# EasyEDA Pro project FOX_HTOL_1.0.eprj, board PCB1 (continued)
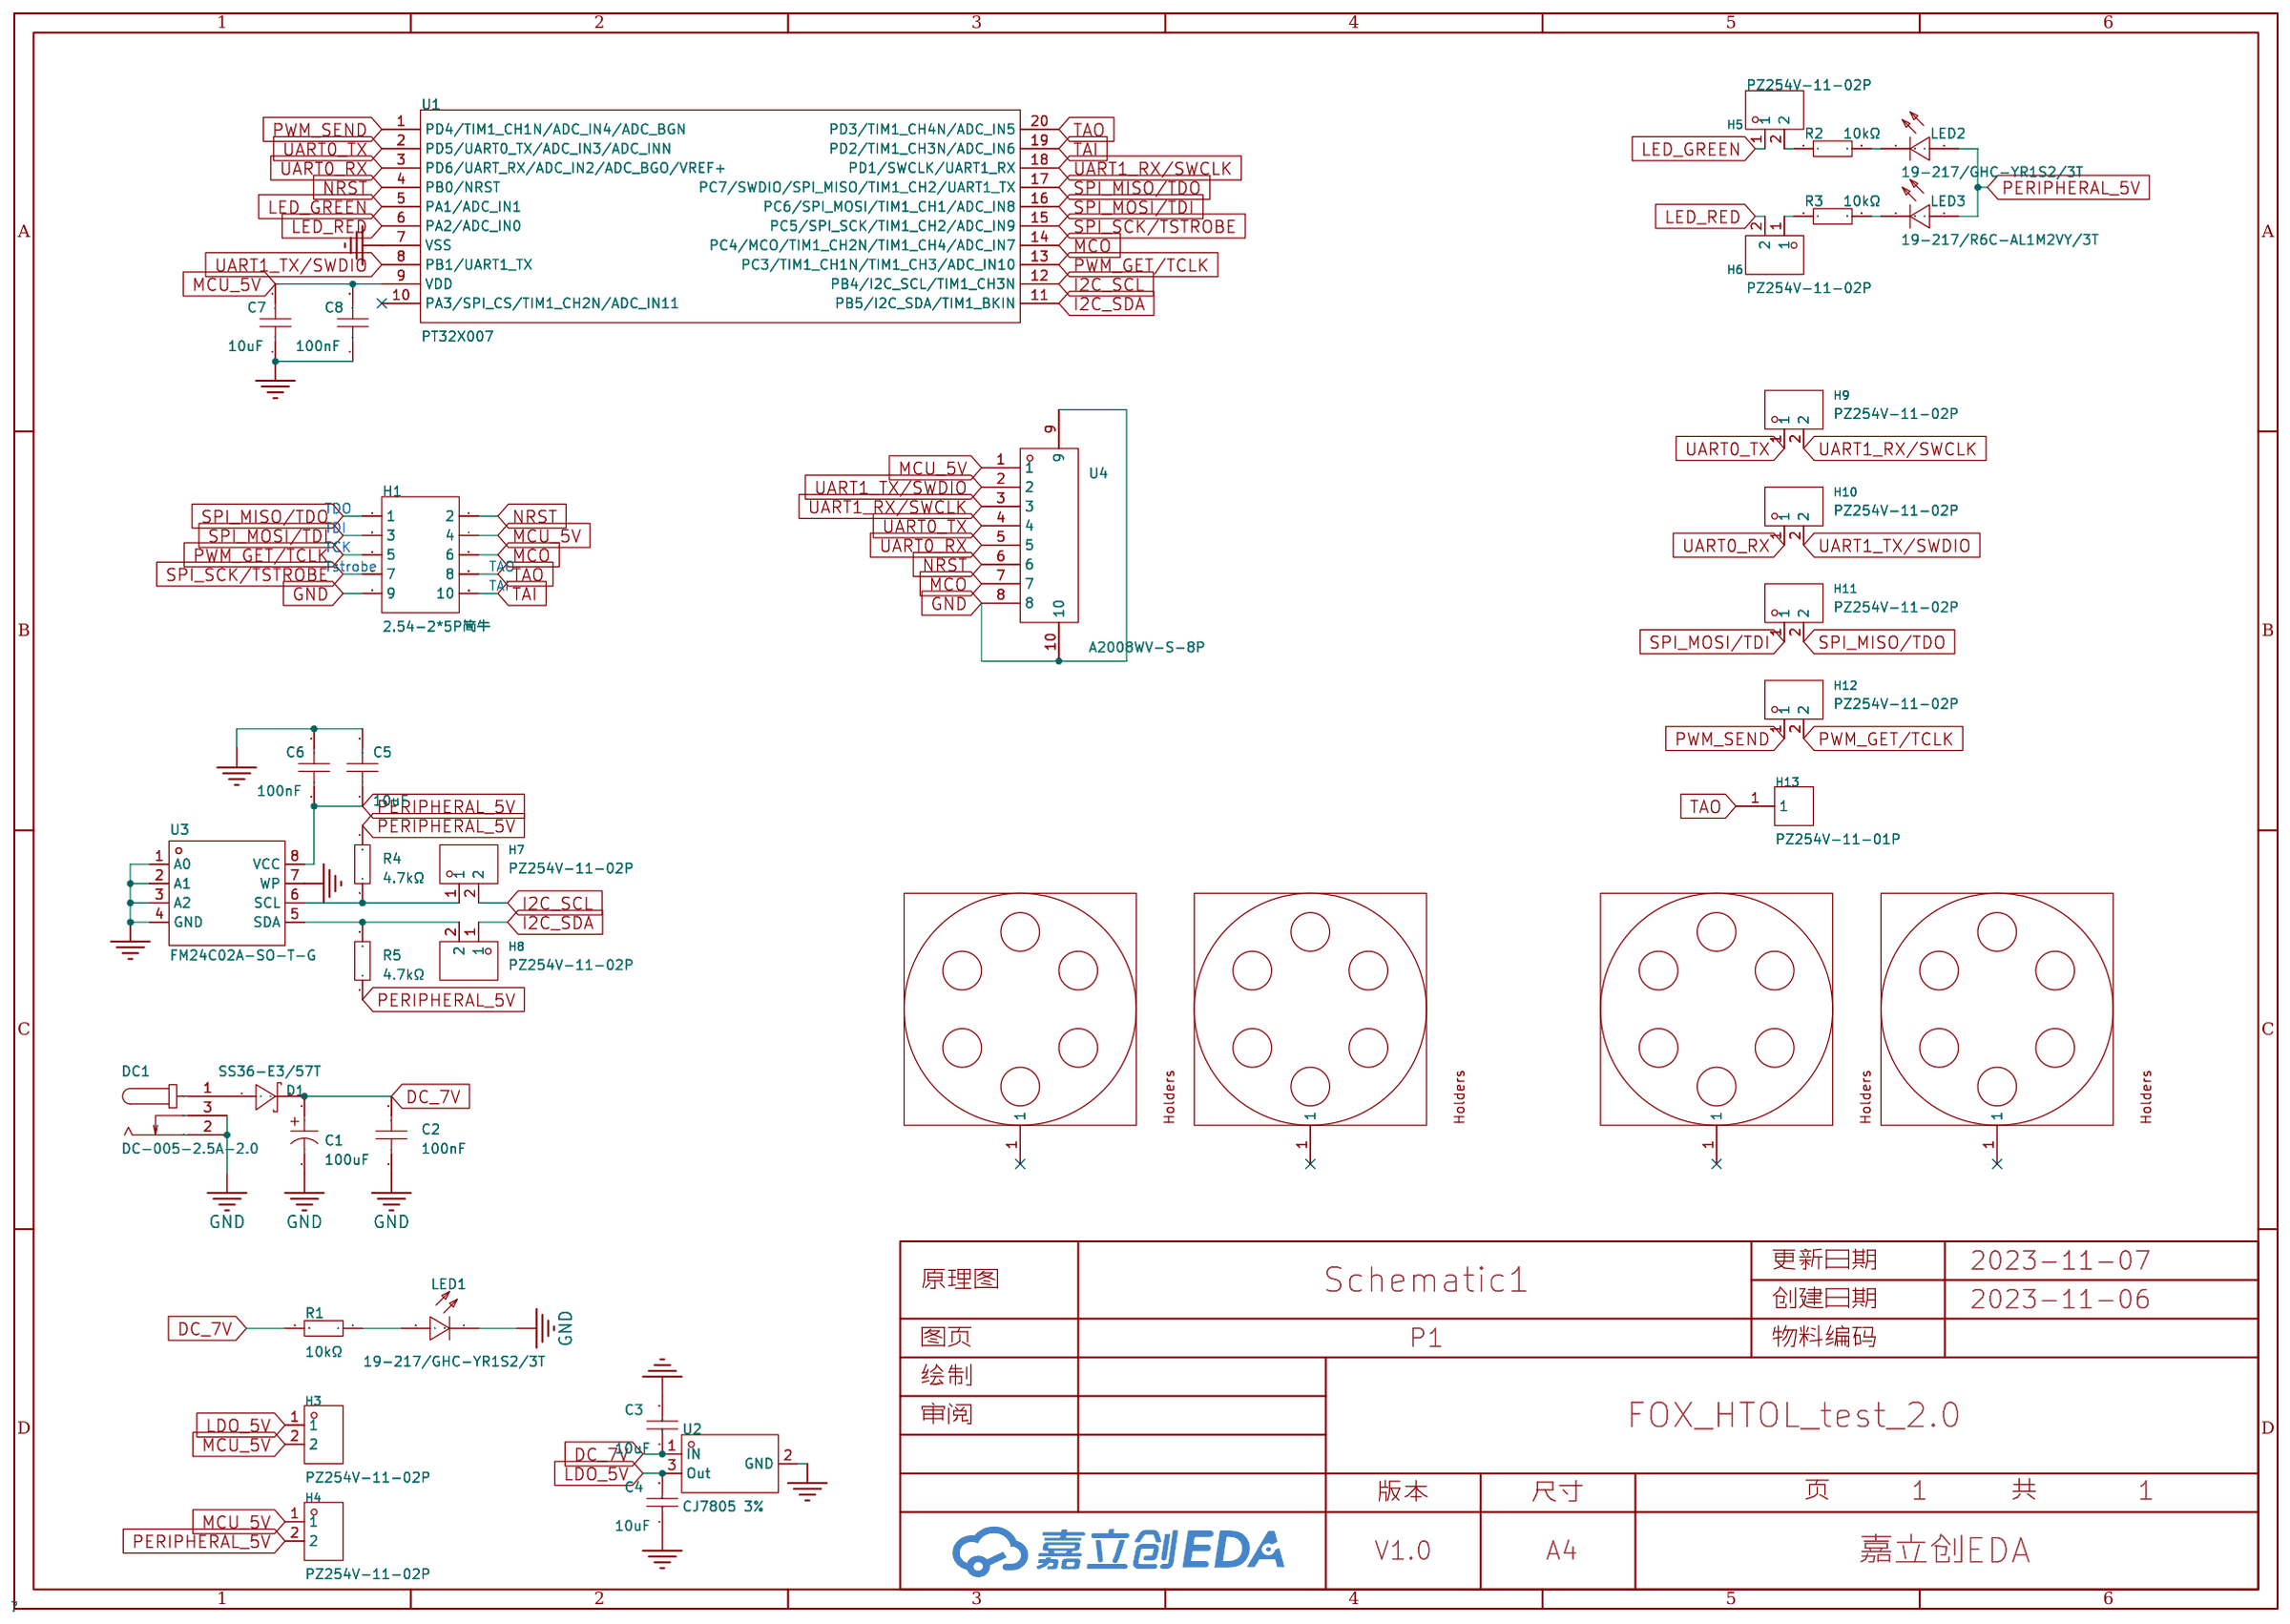
[diagram p0: schematic sheet]
## Routing (per net, layer and track width the routed paths; a pad name or vN(x,y) marks a point on that pad's centre or on a via; arc(x,y) is an arc through that point) (continued)
UART1_RX/SWCLK: length 2204.8
  Top Layer w0.254: U1#28.18 64.22,89.16 66.23,87.16 69.28,87.16 71.44,89.31 71.44,92.74 72.66,93.96 U4#24.3 77.99,93.96 78.55,94.52 78.55,100.24 76.64,102.14 44.39,102.14 43.12,100.87 43.12,98.84 H9#30.2 ; U1#25.18 64.22,57.04 66.23,55.03 69.28,55.03 71.44,57.19 71.44,60.62 72.66,61.84 77.99,61.84 78.55,62.4 78.55,68.11 76.64,70.02 44.39,70.02 43.12,68.75 43.12,66.71 H9#31.2 ; H9.2 119.95,34.59 119.95,36.62 121.22,37.89 153.47,37.89 155.38,35.99 155.38,30.27 154.82,29.72 U4#12.3 149.49,29.72 148.27,28.49 148.27,25.06 146.11,22.91 143.06,22.91 141.05,24.91 U1#12.18 ; U1#11.18 141.05,57.04 143.06,55.03 146.11,55.03 148.27,57.19 148.27,60.62 149.49,61.84 154.82,61.84 155.38,62.4 155.38,68.11 153.47,70.02 121.22,70.02 119.95,68.75 119.95,66.71 H9#16.2 ; U1#13.18 141.05,217.66 143.06,215.65 146.11,215.65 148.27,217.81 148.27,221.24 149.49,222.46 U4#16.3 154.82,222.46 155.38,223.02 155.38,228.73 153.47,230.64 121.22,230.64 119.95,229.37 119.95,227.34 H9#12.2 ; U1#24.18 64.22,121.29 66.23,119.28 69.28,119.28 71.44,121.44 71.44,124.87 72.66,126.09 U4#32.3 77.99,126.09 78.55,126.65 78.55,132.36 76.64,134.27 44.39,134.27 43.12,133 43.12,130.96 H9#24.2 ; H9#14.2 119.95,163.09 119.95,165.12 121.22,166.39 153.47,166.39 155.38,164.48 155.38,158.77 154.82,158.21 U4#14.3 149.49,158.21 148.27,156.99 148.27,153.56 146.11,151.4 143.06,151.4 141.05,153.41 U1#17.18 ; U1#18.18 25.81,153.41 27.81,151.4 30.86,151.4 33.02,153.56 33.02,156.99 34.24,158.21 U4#19.3 39.58,158.21 40.13,158.77 40.13,164.48 38.23,166.39 5.97,166.39 4.7,165.12 4.7,163.09 H9#19.2 ; H9#17.2 119.95,195.21 119.95,197.24 121.22,198.51 153.47,198.51 155.38,196.61 155.38,190.89 154.82,190.34 U4#13.3 149.49,190.34 148.27,189.12 148.27,185.69 146.11,183.53 143.06,183.53 141.05,185.53 U1#16.18 ; U1#6.18 102.64,89.16 104.65,87.16 107.69,87.16 109.85,89.31 109.85,92.74 111.07,93.96 U4.3 116.41,93.96 116.96,94.52 116.96,100.24 115.06,102.14 82.8,102.14 81.53,100.87 81.53,98.84 H9#7.2 ; H9#5.2 81.53,259.46 81.53,261.49 82.8,262.76 115.06,262.76 116.96,260.86 116.96,255.14 116.41,254.59 U4#6.3 111.07,254.59 109.85,253.36 109.85,249.94 107.69,247.78 104.65,247.78 102.64,249.78 100.78,249.78 ; 23.95,249.78 25.81,249.78 27.81,247.78 30.86,247.78 33.02,249.94 33.02,253.36 34.24,254.59 U4#9.3 39.58,254.59 40.13,255.14 40.13,260.86 38.23,262.76 5.97,262.76 4.7,261.49 4.7,259.46 H9#10.2 ; H9#29.2 43.12,163.09 43.12,165.12 44.39,166.39 76.64,166.39 78.55,164.48 78.55,158.77 77.99,158.21 U4#28.3 72.66,158.21 71.44,156.99 71.44,153.56 69.28,151.4 66.23,151.4 64.22,153.41 U1#32.18 ; H9#22.2 4.7,66.71 4.7,68.75 5.97,70.02 38.23,70.02 40.13,68.11 40.13,62.4 39.58,61.84 34.24,61.84 33.02,60.62 33.02,57.19 30.86,55.03 27.81,55.03 25.81,57.04 U1#21.18 ; U1#30.18 64.22,185.53 66.23,183.53 69.28,183.53 71.44,185.69 71.44,189.12 72.66,190.34 U4#27.3 77.99,190.34 78.55,190.89 78.55,196.61 76.64,198.51 44.39,198.51 43.12,197.24 43.12,195.21 H9#32.2 ; U1#5.18 102.64,217.66 104.65,215.65 107.69,215.65 109.85,217.81 109.85,221.24 111.07,222.46 U4#7.3 116.41,222.46 116.96,223.02 116.96,228.73 115.06,230.64 82.8,230.64 81.53,229.37 81.53,227.34 H9#3.2 ; U1#2.18 102.64,121.29 104.65,119.28 107.69,119.28 109.85,121.44 109.85,124.87 111.07,126.09 U4#8.3 116.41,126.09 116.96,126.65 116.96,132.36 115.06,134.27 82.8,134.27 81.53,133 81.53,130.96 H9#2.2 ; H9#26.2 43.12,34.59 43.12,36.62 44.39,37.89 76.64,37.89 78.55,35.99 78.55,30.27 77.99,29.72 U4#26.3 72.66,29.72 71.44,28.49 71.44,25.06 69.28,22.91 66.23,22.91 64.22,24.91 U1#26.18 ; U1#19.18 25.81,24.91 27.81,22.91 30.86,22.91 33.02,25.06 33.02,28.49 34.24,29.72 U4#20.3 39.58,29.72 40.13,30.27 40.13,35.99 38.23,37.89 5.97,37.89 4.7,36.62 4.7,34.59 H9#20.2 ; U1#31.18 25.81,185.53 27.81,183.53 30.86,183.53 33.02,185.69 33.02,189.12 34.24,190.34 U4#18.3 39.58,190.34 40.13,190.89 40.13,196.61 38.23,198.51 5.97,198.51 4.7,197.24 4.7,195.21 H9#18.2 ; U1#20.18 25.81,89.16 27.81,87.16 30.86,87.16 33.02,89.31 33.02,92.74 34.24,93.96 U4#22.3 39.58,93.96 40.13,94.52 40.13,100.24 38.23,102.14 5.97,102.14 4.7,100.87 4.7,98.84 H9#21.2 ; H9#11.2 119.95,130.96 119.95,133 121.22,134.27 153.47,134.27 155.38,132.36 155.38,126.65 154.82,126.09 U4#17.3 149.49,126.09 148.27,124.87 148.27,121.44 146.11,119.28 143.06,119.28 141.05,121.29 U1#10.18 ; U1#3.18 102.64,57.04 104.65,55.03 107.69,55.03 109.85,57.19 109.85,60.62 111.07,61.84 116.41,61.84 116.96,62.4 116.96,68.11 115.06,70.02 82.8,70.02 81.53,68.75 81.53,66.71 H9#8.2 ; H9#28.2 4.7,227.34 4.7,229.37 5.97,230.64 38.23,230.64 40.13,228.73 40.13,223.02 39.58,222.46 U4#31.3 34.24,222.46 33.02,221.24 33.02,217.81 30.86,215.65 27.81,215.65 25.81,217.66 U1#23.18 ; H9#23.2 4.7,130.96 4.7,133 5.97,134.27 38.23,134.27 40.13,132.36 40.13,126.65 39.58,126.09 U4#23.3 34.24,126.09 33.02,124.87 33.02,121.44 30.86,119.28 27.81,119.28 25.81,121.29 U1#22.18 ; U1#14.18 141.05,89.16 143.06,87.16 146.11,87.16 148.27,89.31 148.27,92.74 149.49,93.96 U4#10.3 154.82,93.96 155.38,94.52 155.38,100.24 153.47,102.14 121.22,102.14 119.95,100.87 119.95,98.84 H9#15.2 ; H9#4.2 81.53,34.59 81.53,36.62 82.8,37.89 115.06,37.89 116.96,35.99 116.96,30.27 116.41,29.72 U4#3.3 111.07,29.72 109.85,28.49 109.85,25.06 107.69,22.91 104.65,22.91 102.64,24.91 U1#4.18 ; U1#8.18 102.64,185.53 104.65,183.53 107.69,183.53 109.85,185.69 109.85,189.12 111.07,190.34 U4#4.3 116.41,190.34 116.96,190.89 116.96,196.61 115.06,198.51 82.8,198.51 81.53,197.24 81.53,195.21 H9#9.2 ; U1#9.18 102.64,153.41 104.65,151.4 107.69,151.4 109.85,153.56 109.85,156.99 111.07,158.21 U4#5.3 116.41,158.21 116.96,158.77 116.96,164.48 115.06,166.39 82.8,166.39 81.53,165.12 81.53,163.09 H9#6.2 ; 62.37,249.78 64.22,249.78 66.23,247.78 69.28,247.78 71.44,249.94 71.44,253.36 72.66,254.59 U4#29.3 77.99,254.59 78.55,255.14 78.55,260.86 76.64,262.76 44.39,262.76 43.12,261.49 43.12,259.46 H9#27.2 ; U1#27.18 64.22,217.66 66.23,215.65 69.28,215.65 71.44,217.81 71.44,221.24 72.66,222.46 U4#30.3 77.99,222.46 78.55,223.02 78.55,228.73 76.64,230.64 44.39,230.64 43.12,229.37 43.12,227.34 H9#25.2 ; 139.2,249.78 141.05,249.78 143.06,247.78 146.11,247.78 148.27,249.94 148.27,253.36 149.49,254.59 U4#15.3 154.82,254.59 155.38,255.14 155.38,260.86 153.47,262.76 121.22,262.76 119.95,261.49 119.95,259.46 H9#13.2
UART1_TX/SWDIO: length 2264.1
  Top Layer w0.254: v2(132.27,53.76) 133.43,53.76 U1#11.8 135.44,53.79 135.82,54.17 135.82,59.22 v2(135.44,59.6) ; v2(93.85,150.13) 95.02,150.13 U1#9.8 97.03,150.16 97.41,150.54 97.41,155.59 v2(97.03,155.98) ; v2(93.85,85.88) 95.02,85.88 U1#6.8 97.03,85.91 97.41,86.29 97.41,91.35 v2(97.03,91.73) ; v2(135.44,252.35) 135.82,251.97 135.82,246.91 135.44,246.53 133.46,246.53 133.43,246.51 v2(132.27,246.51) ; v2(132.27,150.13) 133.43,150.13 U1#17.8 135.44,150.16 135.82,150.54 135.82,155.59 v2(135.44,155.98) ; v2(135.44,123.85) 135.82,123.47 135.82,118.42 135.44,118.04 U1#10.8 133.43,118.01 v2(132.27,118.01) ; v2(135.44,27.48) 135.82,27.1 135.82,22.04 135.44,21.66 U1#12.8 133.43,21.64 v2(132.27,21.64) ; v2(132.27,182.26) 133.43,182.26 U1#16.8 135.44,182.28 135.82,182.66 135.82,187.72 v2(135.44,188.1) ; v2(20.19,123.85) 20.57,123.47 20.57,118.42 20.19,118.04 U1#22.8 18.19,118.01 v2(17.02,118.01) ; v2(17.02,21.64) 18.19,21.64 U1#19.8 20.19,21.66 20.57,22.04 20.57,27.1 v2(20.19,27.48) ; v2(55.43,118.01) 56.6,118.01 U1#24.8 58.61,118.04 58.99,118.42 58.99,123.47 v2(58.61,123.85) ; v2(55.43,21.64) 56.6,21.64 U1#26.8 58.61,21.66 58.99,22.04 58.99,27.1 v2(58.61,27.48) ; v2(20.19,91.73) 20.57,91.35 20.57,86.29 20.19,85.91 U1#20.8 18.19,85.88 v2(17.02,85.88) ; v2(20.19,220.22) 20.57,219.84 20.57,214.79 20.19,214.41 U1#23.8 18.19,214.38 v2(17.02,214.38) ; v2(93.85,182.26) 95.02,182.26 U1#8.8 97.03,182.28 97.41,182.66 97.41,187.72 v2(97.03,188.1) ; v2(58.61,59.6) 58.99,59.22 58.99,54.17 58.61,53.79 U1#25.8 56.6,53.76 v2(55.43,53.76) ; v2(55.43,246.51) 56.6,246.51 56.63,246.53 58.61,246.53 58.99,246.91 58.99,251.97 v2(58.61,252.35) ; v2(135.44,220.22) 135.82,219.84 135.82,214.79 135.44,214.41 U1#13.8 133.43,214.38 v2(132.27,214.38) ; v2(58.61,220.22) 58.99,219.84 58.99,214.79 58.61,214.41 U1#27.8 56.6,214.38 v2(55.43,214.38) ; v2(58.61,188.1) 58.99,187.72 58.99,182.66 58.61,182.28 U1#30.8 56.6,182.26 v2(55.43,182.26) ; v2(97.03,59.6) 97.41,59.22 97.41,54.17 97.03,53.79 U1#3.8 95.02,53.76 v2(93.85,53.76) ; v2(93.85,21.64) 95.02,21.64 U1#4.8 97.03,21.66 97.41,22.04 97.41,27.1 v2(97.03,27.48) ; v2(20.19,188.1) 20.57,187.72 20.57,182.66 20.19,182.28 U1#31.8 18.19,182.26 v2(17.02,182.26) ; v2(20.19,155.98) 20.57,155.59 20.57,150.54 20.19,150.16 U1#18.8 18.19,150.13 v2(17.02,150.13) ; v2(20.19,252.35) 20.57,251.97 20.57,246.91 20.19,246.53 18.21,246.53 18.19,246.51 v2(17.02,246.51) ; v2(93.85,118.01) 95.02,118.01 U1#2.8 97.03,118.04 97.41,118.42 97.41,123.47 v2(97.03,123.85) ; v2(93.85,246.51) 95.02,246.51 95.04,246.53 97.03,246.53 97.41,246.91 97.41,251.97 v2(97.03,252.35) ; v2(17.02,53.76) 18.19,53.76 U1#21.8 20.19,53.79 20.57,54.17 20.57,59.22 v2(20.19,59.6) ; v2(58.61,155.98) 58.99,155.59 58.99,150.54 58.61,150.16 U1#32.8 56.6,150.13 v2(55.43,150.13) ; v2(97.03,220.22) 97.41,219.84 97.41,214.79 97.03,214.41 U1#5.8 95.02,214.38 v2(93.85,214.38) ; v2(55.43,85.88) 56.6,85.88 U1#28.8 58.61,85.91 58.99,86.29 58.99,91.35 v2(58.61,91.73) ; v2(132.27,85.88) 133.43,85.88 U1#14.8 135.44,85.91 135.82,86.29 135.82,91.35 v2(135.44,91.73)
  Bottom Layer w0.254: H10#12.2 118.8,220.35 118.8,206.13 121.47,203.46 123.88,203.46 126.68,206.25 126.68,211.72 127.44,212.48 131.25,212.48 131.88,213.11 131.88,214 v2(132.27,214.38) ; v2(115.44,63.79) 111,63.79 108.33,61.13 98.04,61.13 97.03,60.11 v2(97.03,59.6) ; v2(38.61,128.04) 34.16,128.04 31.5,125.38 21.21,125.38 20.19,124.36 v2(20.19,123.85) ; v2(20.19,91.73) 20.19,92.23 21.21,93.25 31.5,93.25 34.16,95.92 v2(38.61,95.92) ; v2(55.43,182.26) 55.05,181.88 55.05,180.99 54.42,180.35 50.61,180.35 49.85,179.59 49.85,174.13 47.05,171.34 44.64,171.34 41.97,174 41.97,188.23 H10#31.2 ; v2(135.44,27.48) 135.44,27.99 136.46,29 146.74,29 149.41,31.67 v2(153.86,31.67) ; v2(55.43,21.64) 55.05,21.25 55.05,20.37 54.42,19.73 50.61,19.73 49.85,18.97 49.85,13.51 47.05,10.71 44.64,10.71 41.97,13.38 41.97,27.6 H10#30.2 ; H10.2 80.39,123.98 80.39,109.75 83.06,107.09 85.47,107.09 88.26,109.88 88.26,115.34 89.02,116.1 92.83,116.1 93.47,116.74 93.47,117.63 v2(93.85,118.01) ; H10#24.2 41.97,123.98 41.97,109.75 44.64,107.09 47.05,107.09 49.85,109.88 49.85,115.34 50.61,116.1 54.42,116.1 55.05,116.74 55.05,117.63 v2(55.43,118.01) ; v2(153.86,256.54) 149.41,256.54 146.74,253.87 136.46,253.87 135.44,252.86 v2(135.44,252.35) ; H10#25.2 41.97,252.48 41.97,238.25 44.64,235.58 47.05,235.58 49.85,238.38 49.85,243.84 50.61,244.6 54.42,244.6 55.05,245.24 55.05,246.13 v2(55.43,246.51) ; v2(20.19,220.22) 20.19,220.73 21.21,221.75 31.5,221.75 34.16,224.42 v2(38.61,224.42) ; H10#32.2 41.97,91.85 41.97,77.63 44.64,74.96 47.05,74.96 49.85,77.76 49.85,83.22 50.61,83.98 54.42,83.98 55.05,84.61 55.05,85.5 v2(55.43,85.88) ; v2(132.27,85.88) 131.88,85.5 131.88,84.61 131.25,83.98 127.44,83.98 126.68,83.22 126.68,77.76 123.88,74.96 121.47,74.96 118.8,77.63 118.8,91.85 H10#17.2 ; v2(77.02,31.67) 72.58,31.67 69.91,29 59.62,29 58.61,27.99 v2(58.61,27.48) ; v2(77.02,128.04) 72.58,128.04 69.91,125.38 59.62,125.38 58.61,124.36 v2(58.61,123.85) ; v2(58.61,91.73) 58.61,92.23 59.62,93.25 69.91,93.25 72.58,95.92 v2(77.02,95.92) ; v2(38.61,160.17) 34.16,160.17 31.5,157.5 21.21,157.5 20.19,156.48 v2(20.19,155.98) ; H10#10.2 118.8,123.98 118.8,109.75 121.47,107.09 123.88,107.09 126.68,109.88 126.68,115.34 127.44,116.1 131.25,116.1 131.88,116.74 131.88,117.63 v2(132.27,118.01) ; v2(77.02,63.79) 72.58,63.79 69.91,61.13 59.62,61.13 58.61,60.11 v2(58.61,59.6) ; v2(97.03,123.85) 97.03,124.36 98.04,125.38 108.33,125.38 111,128.04 v2(115.44,128.04) ; v2(132.27,246.51) 131.88,246.13 131.88,245.24 131.25,244.6 127.44,244.6 126.68,243.84 126.68,238.38 123.88,235.58 121.47,235.58 118.8,238.25 118.8,252.48 H10#11.2 ; H10#29.2 41.97,59.73 41.97,45.51 44.64,42.84 47.05,42.84 49.85,45.63 49.85,51.09 50.61,51.86 54.42,51.86 55.05,52.49 55.05,53.38 v2(55.43,53.76) ; H10#19.2 3.56,156.1 3.56,141.88 6.22,139.21 8.64,139.21 11.43,142.01 11.43,147.47 12.19,148.23 16,148.23 16.64,148.86 16.64,149.75 v2(17.02,150.13) ; v2(97.03,27.48) 97.03,27.99 98.04,29 108.33,29 111,31.67 v2(115.44,31.67) ; H10#9.2 3.56,252.48 3.56,238.25 6.22,235.58 8.64,235.58 11.43,238.38 11.43,243.84 12.19,244.6 16,244.6 16.64,245.24 16.64,246.13 v2(17.02,246.51) ; v2(38.61,192.29) 34.16,192.29 31.5,189.62 21.21,189.62 20.19,188.61 v2(20.19,188.1) ; v2(97.03,91.73) 97.03,92.23 98.04,93.25 108.33,93.25 111,95.92 v2(115.44,95.92) ; v2(93.85,85.88) 93.47,85.5 93.47,84.61 92.83,83.98 89.02,83.98 88.26,83.22 88.26,77.76 85.47,74.96 83.06,74.96 80.39,77.63 80.39,91.85 H10#8.2 ; v2(132.27,150.13) 131.88,149.75 131.88,148.86 131.25,148.23 127.44,148.23 126.68,147.47 126.68,142.01 123.88,139.21 121.47,139.21 118.8,141.88 118.8,156.1 H10#13.2 ; v2(58.61,188.1) 58.61,188.61 59.62,189.62 69.91,189.62 72.58,192.29 v2(77.02,192.29) ; H10#14.2 118.8,59.73 118.8,45.51 121.47,42.84 123.88,42.84 126.68,45.63 126.68,51.09 127.44,51.86 131.25,51.86 131.88,52.49 131.88,53.38 v2(132.27,53.76) ; v2(38.61,63.79) 34.16,63.79 31.5,61.13 21.21,61.13 20.19,60.11 v2(20.19,59.6) ; v2(135.44,59.6) 135.44,60.11 136.46,61.13 146.74,61.13 149.41,63.79 v2(153.86,63.79) ; v2(17.02,21.64) 16.64,21.25 16.64,20.37 16,19.73 12.19,19.73 11.43,18.97 11.43,13.51 8.64,10.71 6.22,10.71 3.56,13.38 3.56,27.6 H10#20.2 ; v2(135.44,91.73) 135.44,92.23 136.46,93.25 146.74,93.25 149.41,95.92 v2(153.86,95.92) ; v2(20.19,27.48) 20.19,27.99 21.21,29 31.5,29 34.16,31.67 v2(38.61,31.67) ; v2(153.86,224.42) 149.41,224.42 146.74,221.75 136.46,221.75 135.44,220.73 v2(135.44,220.22) ; v2(135.44,188.1) 135.44,188.61 136.46,189.62 146.74,189.62 149.41,192.29 v2(153.86,192.29) ; v2(58.61,155.98) 58.61,156.48 59.62,157.5 69.91,157.5 72.58,160.17 v2(77.02,160.17) ; v2(97.03,220.22) 97.03,220.73 98.04,221.75 108.33,221.75 111,224.42 v2(115.44,224.42) ; H10#18.2 3.56,188.23 3.56,174 6.22,171.34 8.64,171.34 11.43,174.13 11.43,179.59 12.19,180.35 16,180.35 16.64,180.99 16.64,181.88 v2(17.02,182.26) ; H10#5.2 80.39,59.73 80.39,45.51 83.06,42.84 85.47,42.84 88.26,45.63 88.26,51.09 89.02,51.86 92.83,51.86 93.47,52.49 93.47,53.38 v2(93.85,53.76) ; v2(93.85,150.13) 93.47,149.75 93.47,148.86 92.83,148.23 89.02,148.23 88.26,147.47 88.26,142.01 85.47,139.21 83.06,139.21 80.39,141.88 80.39,156.1 H10#4.2 ; v2(77.02,256.54) 72.58,256.54 69.91,253.87 59.62,253.87 58.61,252.86 v2(58.61,252.35) ; H10#15.2 118.8,27.6 118.8,13.38 121.47,10.71 123.88,10.71 126.68,13.51 126.68,18.97 127.44,19.73 131.25,19.73 131.88,20.37 131.88,21.25 v2(132.27,21.64) ; v2(38.61,256.54) 34.16,256.54 31.5,253.87 21.21,253.87 20.19,252.86 v2(20.19,252.35) ; v2(55.43,150.13) 55.05,149.75 55.05,148.86 54.42,148.23 50.61,148.23 49.85,147.47 49.85,142.01 47.05,139.21 44.64,139.21 41.97,141.88 41.97,156.1 H10#28.2 ; v2(135.44,155.98) 135.44,156.48 136.46,157.5 146.74,157.5 149.41,160.17 v2(153.86,160.17) ; v2(93.85,21.64) 93.47,21.25 93.47,20.37 92.83,19.73 89.02,19.73 88.26,18.97 88.26,13.51 85.47,10.71 83.06,10.71 80.39,13.38 80.39,27.6 H10#6.2 ; H10#22.2 3.56,59.73 3.56,45.51 6.22,42.84 8.64,42.84 11.43,45.63 11.43,51.09 12.19,51.86 16,51.86 16.64,52.49 16.64,53.38 v2(17.02,53.76) ; H10#26.2 41.97,220.35 41.97,206.13 44.64,203.46 47.05,203.46 49.85,206.25 49.85,211.72 50.61,212.48 54.42,212.48 55.05,213.11 55.05,214 v2(55.43,214.38) ; H10#23.2 3.56,123.98 3.56,109.75 6.22,107.09 8.64,107.09 11.43,109.88 11.43,115.34 12.19,116.1 16,116.1 16.64,116.74 16.64,117.63 v2(17.02,118.01) ; v2(135.44,123.85) 135.44,124.36 136.46,125.38 146.74,125.38 149.41,128.04 v2(153.86,128.04) ; H10#7.2 80.39,188.23 80.39,174 83.06,171.34 85.47,171.34 88.26,174.13 88.26,179.59 89.02,180.35 92.83,180.35 93.47,180.99 93.47,181.88 v2(93.85,182.26) ; v2(132.27,182.26) 131.88,181.88 131.88,180.99 131.25,180.35 127.44,180.35 126.68,179.59 126.68,174.13 123.88,171.34 121.47,171.34 118.8,174 118.8,188.23 H10#16.2 ; v2(17.02,214.38) 16.64,214 16.64,213.11 16,212.48 12.19,212.48 11.43,211.72 11.43,206.25 8.64,203.46 6.22,203.46 3.56,206.13 3.56,220.35 H10#27.2 ; v2(93.85,214.38) 93.47,214 93.47,213.11 92.83,212.48 89.02,212.48 88.26,211.72 88.26,206.25 85.47,203.46 83.06,203.46 80.39,206.13 80.39,220.35 H10#3.2 ; v2(115.44,256.54) 111,256.54 108.33,253.87 98.04,253.87 97.03,252.86 v2(97.03,252.35) ; v2(115.44,192.29) 111,192.29 108.33,189.62 98.04,189.62 97.03,188.61 v2(97.03,188.1) ; v2(17.02,85.88) 16.64,85.5 16.64,84.61 16,83.98 12.19,83.98 11.43,83.22 11.43,77.76 8.64,74.96 6.22,74.96 3.56,77.63 3.56,91.85 H10#21.2 ; v2(93.85,246.51) 93.47,246.13 93.47,245.24 92.83,244.6 89.02,244.6 88.26,243.84 88.26,238.38 85.47,235.58 83.06,235.58 80.39,238.25 80.39,252.48 H10#2.2 ; v2(115.44,160.17) 111,160.17 108.33,157.5 98.04,157.5 97.03,156.48 v2(97.03,155.98) ; v2(58.61,220.22) 58.61,220.73 59.62,221.75 69.91,221.75 72.58,224.42 v2(77.02,224.42)
$1N831: length 9.4
  Top Layer w2: D1.1 14.62,283.21 DC1.1
$1N1246: length 1.5
  Top Layer w0.254: LED1.2 34.8,280.2 R1.1
$1N1959: length 1526.9
  Top Layer w0.254: v1(144.71,106.96) 144.05,106.3 120.73,106.3 118.17,108.87 118.17,120.8 H5#9.2 ; H5#29.2 41.34,88.68 41.34,76.74 43.9,74.18 67.22,74.18 v1(67.88,74.84) ; H5#23.2 41.34,120.8 41.34,108.87 43.9,106.3 67.22,106.3 v1(67.88,106.96) ; H5#12.2 118.17,152.93 118.17,140.99 120.73,138.43 144.05,138.43 v1(144.71,139.08) ; H5#25.2 41.34,217.18 41.34,205.24 43.9,202.67 67.22,202.67 v1(67.88,203.33) ; v1(29.46,235.46) 28.81,234.8 5.48,234.8 2.92,237.36 2.92,249.3 H5#32.2 ; v1(29.46,74.84) 28.81,74.18 5.48,74.18 2.92,76.74 2.92,88.68 H5#20.2 ; H5#16.2 118.17,249.3 118.17,237.36 120.73,234.8 144.05,234.8 v1(144.71,235.46) ; H5#7.2 79.75,56.55 79.75,44.62 82.32,42.05 105.64,42.05 v1(106.3,42.71) ; H5#30.2 41.34,56.55 41.34,44.62 43.9,42.05 67.22,42.05 v1(67.88,42.71) ; v1(106.3,74.84) 105.64,74.18 82.32,74.18 79.75,76.74 79.75,88.68 H5#6.2 ; H5#8.2 79.75,249.3 79.75,237.36 82.32,234.8 105.64,234.8 v1(106.3,235.46) ; H5#27.2 41.34,152.93 41.34,140.99 43.9,138.43 67.22,138.43 v1(67.88,139.08) ; v1(106.3,10.59) 105.64,9.93 82.32,9.93 79.75,12.49 79.75,24.43 H5#2.2 ; H5#13.2 118.17,185.05 118.17,173.11 120.73,170.55 144.05,170.55 v1(144.71,171.21) ; v1(144.71,203.33) 144.05,202.67 120.73,202.67 118.17,205.24 118.17,217.18 H5#11.2 ; H5.2 79.75,120.8 79.75,108.87 82.32,106.3 105.64,106.3 v1(106.3,106.96) ; H5#21.2 2.92,56.55 2.92,44.62 5.48,42.05 28.81,42.05 v1(29.46,42.71) ; H5#26.2 2.92,217.18 2.92,205.24 5.48,202.67 28.81,202.67 v1(29.46,203.33) ; v1(144.71,42.71) 144.05,42.05 120.73,42.05 118.17,44.62 118.17,56.55 H5#15.2 ; v1(144.71,10.59) 144.05,9.93 120.73,9.93 118.17,12.49 118.17,24.43 H5#10.2 ; H5#3.2 79.75,217.18 79.75,205.24 82.32,202.67 105.64,202.67 v1(106.3,203.33) ; v1(144.71,74.84) 144.05,74.18 120.73,74.18 118.17,76.74 118.17,88.68 H5#14.2 ; H5#5.2 79.75,185.05 79.75,173.11 82.32,170.55 105.64,170.55 v1(106.3,171.21) ; v1(29.46,10.59) 28.81,9.93 5.48,9.93 2.92,12.49 2.92,24.43 H5#19.2 ; v1(67.88,171.21) 67.22,170.55 43.9,170.55 41.34,173.11 41.34,185.05 H5#28.2 ; v1(67.88,235.46) 67.22,234.8 43.9,234.8 41.34,237.36 41.34,249.3 H5#31.2 ; v1(29.46,106.96) 28.81,106.3 5.48,106.3 2.92,108.87 2.92,120.8 H5#22.2 ; v1(29.46,171.21) 28.81,170.55 5.48,170.55 2.92,173.11 2.92,185.05 H5#17.2 ; v1(106.3,139.08) 105.64,138.43 82.32,138.43 79.75,140.99 79.75,152.93 H5#4.2 ; v1(67.88,10.59) 67.22,9.93 43.9,9.93 41.34,12.49 41.34,24.43 H5#24.2 ; v1(29.46,139.08) 28.81,138.43 5.48,138.43 2.92,140.99 2.92,152.93 H5#18.2
  Bottom Layer w0.254: v1(29.46,42.71) 29.46,45.75 v1(29.46,45.76) ; v1(67.87,174.26) 67.88,174.25 v1(67.88,171.21) ; v1(29.46,235.46) 29.46,238.5 v1(29.46,238.51) ; v1(106.29,206.38) 106.3,206.37 v1(106.3,203.33) ; v1(29.46,106.96) 29.46,110 v1(29.46,110.01) ; v1(144.71,106.96) 144.71,110 v1(144.7,110.01) ; v1(144.7,174.26) 144.71,174.25 v1(144.71,171.21) ; v1(106.29,45.76) 106.3,45.75 v1(106.3,42.71) ; v1(67.87,238.51) 67.88,238.5 v1(67.88,235.46) ; v1(144.7,142.13) 144.71,142.12 v1(144.71,139.08) ; v1(29.46,174.26) 29.46,174.25 v1(29.46,171.21) ; v1(67.87,45.76) 67.88,45.75 v1(67.88,42.71) ; v1(67.88,74.84) 67.88,77.88 v1(67.87,77.88) ; v1(106.3,74.84) 106.3,77.88 v1(106.29,77.88) ; v1(144.71,42.71) 144.71,45.75 v1(144.7,45.76) ; v1(144.71,74.84) 144.71,77.88 v1(144.7,77.88) ; v1(29.46,142.13) 29.46,142.12 v1(29.46,139.08) ; v1(67.87,142.13) 67.88,142.12 v1(67.88,139.08) ; v1(106.3,235.46) 106.3,238.5 v1(106.29,238.51) ; v1(29.46,10.59) 29.46,13.63 v1(29.46,13.63) ; v1(67.88,106.96) 67.88,110 v1(67.87,110.01) ; v1(29.46,203.33) 29.46,206.37 v1(29.46,206.38) ; v1(106.3,139.08) 106.3,142.12 v1(106.29,142.13) ; v1(144.7,206.38) 144.71,206.37 v1(144.71,203.33) ; v1(106.29,174.26) 106.3,174.25 v1(106.3,171.21) ; v1(67.87,13.63) 67.88,13.63 v1(67.88,10.59) ; v1(106.29,13.63) 106.3,13.63 v1(106.3,10.59) ; v1(106.3,106.96) 106.3,110 v1(106.29,110.01) ; v1(144.71,235.46) 144.71,238.5 v1(144.7,238.51) ; v1(67.88,203.33) 67.88,206.37 v1(67.87,206.38) ; v1(29.46,77.88) 29.46,77.88 v1(29.46,74.84) ; v1(144.7,13.63) 144.71,13.63 v1(144.71,10.59)
$1N1962: length 1492
  Top Layer w0.254: H6#19.1 3.33,22.3 3.33,13.22 6.14,10.41 28.4,10.41 30.61,12.62 30.61,15.29 30.35,15.54 29.46,15.54 R3#21.1 ; R3#10.1 144.71,79.79 145.6,79.79 145.85,79.53 145.85,76.87 143.65,74.66 121.39,74.66 118.58,77.47 118.58,86.55 H6#11.1 ; R3#4.1 106.3,144.04 107.19,144.04 107.44,143.78 107.44,141.12 105.23,138.91 82.97,138.91 80.16,141.72 80.16,150.8 H6#5.1 ; R3#18.1 144.71,176.16 145.6,176.16 145.85,175.91 145.85,173.24 143.65,171.03 121.39,171.03 118.58,173.84 118.58,182.92 H6#14.1 ; R3#15.1 144.71,15.54 145.6,15.54 145.85,15.29 145.85,12.62 143.65,10.41 121.39,10.41 118.58,13.22 118.58,22.3 H6#10.1 ; R3#20.1 29.46,79.79 30.35,79.79 30.61,79.53 30.61,76.87 28.4,74.66 6.14,74.66 3.33,77.47 3.33,86.55 H6#20.1 ; H6#12.1 118.58,215.05 118.58,205.97 121.39,203.16 143.65,203.16 145.85,205.37 145.85,208.03 145.6,208.29 144.71,208.29 R3#12.1 ; R3#26.1 67.88,208.29 68.77,208.29 69.02,208.03 69.02,205.37 66.81,203.16 44.56,203.16 41.75,205.97 41.75,215.05 H6#27.1 ; R3#30.1 67.88,47.66 68.77,47.66 69.02,47.41 69.02,44.74 66.81,42.54 44.56,42.54 41.75,45.34 41.75,54.42 H6#30.1 ; R3#25.1 67.88,79.79 68.77,79.79 69.02,79.53 69.02,76.87 66.81,74.66 44.56,74.66 41.75,77.47 41.75,86.55 H6#25.1 ; R3#17.1 144.71,240.41 145.6,240.41 145.85,240.16 145.85,237.49 143.65,235.28 121.39,235.28 118.58,238.09 118.58,247.17 H6#16.1 ; R3#8.1 106.3,240.41 107.19,240.41 107.44,240.16 107.44,237.49 105.23,235.28 82.97,235.28 80.16,238.09 80.16,247.17 H6#8.1 ; H6#24.1 41.75,22.3 41.75,13.22 44.56,10.41 66.81,10.41 69.02,12.62 69.02,15.29 68.77,15.54 67.88,15.54 R3#29.1 ; H6#3.1 80.16,86.55 80.16,77.47 82.97,74.66 105.23,74.66 107.44,76.87 107.44,79.53 107.19,79.79 106.3,79.79 R3.1 ; H6#7.1 80.16,54.42 80.16,45.34 82.97,42.54 105.23,42.54 107.44,44.74 107.44,47.41 107.19,47.66 106.3,47.66 R3#7.1 ; R3#14.1 144.71,111.91 145.6,111.91 145.85,111.66 145.85,108.99 143.65,106.78 121.39,106.78 118.58,109.59 118.58,118.67 H6#9.1 ; R3#9.1 106.3,176.16 107.19,176.16 107.44,175.91 107.44,173.24 105.23,171.03 82.97,171.03 80.16,173.84 80.16,182.92 H6#6.1 ; H6#23.1 41.75,118.67 41.75,109.59 44.56,106.78 66.81,106.78 69.02,108.99 69.02,111.66 68.77,111.91 67.88,111.91 R3#28.1 ; H6#4.1 80.16,215.05 80.16,205.97 82.97,203.16 105.23,203.16 107.44,205.37 107.44,208.03 107.19,208.29 106.3,208.29 R3#3.1 ; R3#24.1 29.46,208.29 30.35,208.29 30.61,208.03 30.61,205.37 28.4,203.16 6.14,203.16 3.33,205.97 3.33,215.05 H6#26.1 ; H6#31.1 41.75,247.17 41.75,238.09 44.56,235.28 66.81,235.28 69.02,237.49 69.02,240.16 68.77,240.41 67.88,240.41 R3#31.1 ; H6#17.1 3.33,182.92 3.33,173.84 6.14,171.03 28.4,171.03 30.61,173.24 30.61,175.91 30.35,176.16 29.46,176.16 R3#11.1 ; R3#32.1 67.88,176.16 68.77,176.16 69.02,175.91 69.02,173.24 66.81,171.03 44.56,171.03 41.75,173.84 41.75,182.92 H6#29.1 ; H6#21.1 3.33,54.42 3.33,45.34 6.14,42.54 28.4,42.54 30.61,44.74 30.61,47.41 30.35,47.66 29.46,47.66 R3#22.1 ; H6.1 80.16,118.67 80.16,109.59 82.97,106.78 105.23,106.78 107.44,108.99 107.44,111.66 107.19,111.91 106.3,111.91 R3#5.1 ; R3#27.1 67.88,144.04 68.77,144.04 69.02,143.78 69.02,141.12 66.81,138.91 44.56,138.91 41.75,141.72 41.75,150.8 H6#28.1 ; R3#19.1 29.46,144.04 30.35,144.04 30.61,143.78 30.61,141.12 28.4,138.91 6.14,138.91 3.33,141.72 3.33,150.8 H6#18.1 ; R3#6.1 106.3,15.54 107.19,15.54 107.44,15.29 107.44,12.62 105.23,10.41 82.97,10.41 80.16,13.22 80.16,22.3 H6#2.1 ; H6#15.1 118.58,54.42 118.58,45.34 121.39,42.54 143.65,42.54 145.85,44.74 145.85,47.41 145.6,47.66 144.71,47.66 R3#16.1 ; H6#32.1 3.33,247.17 3.33,238.09 6.14,235.28 28.4,235.28 30.61,237.49 30.61,240.16 30.35,240.41 29.46,240.41 R3#2.1 ; R3#13.1 144.71,144.04 145.6,144.04 145.85,143.78 145.85,141.12 143.65,138.91 121.39,138.91 118.58,141.72 118.58,150.8 H6#13.1 ; H6#22.1 3.33,118.67 3.33,109.59 6.14,106.78 28.4,106.78 30.61,108.99 30.61,111.66 30.35,111.91 29.46,111.91 R3#23.1
$1N1965: length 51.3
  Top Layer w0.254: R2#32.2 64.78,110.01 LED2#31.1 ; LED2#26.1 64.78,238.51 R2#31.2 ; LED2#28.1 64.78,174.26 R2#28.2 ; R2#26.2 64.78,13.63 LED2#25.1 ; R2#9.2 103.2,238.51 LED2#3.1 ; LED2#16.1 141.61,142.13 R2#11.2 ; R2#8.2 103.2,45.76 LED2#7.1 ; R2#2.2 103.2,142.13 LED2#8.1 ; LED2#12.1 141.61,238.51 R2#17.2 ; R2#21.2 26.36,77.88 LED2#21.1 ; LED2#17.1 141.61,110.01 R2#18.2 ; R2#10.2 103.2,110.01 LED2#9.1 ; R2#22.2 26.36,45.76 LED2#22.1 ; R2#27.2 64.78,206.38 LED2#27.1 ; R2#29.2 64.78,77.88 LED2#32.1 ; R2#13.2 141.61,206.38 LED2#13.1 ; LED2#5.1 103.2,174.26 R2#5.2 ; LED2#15.1 141.61,45.76 R2#16.2 ; LED2#11.1 141.61,13.63 R2#12.2 ; LED2#29.1 64.78,45.76 R2#30.2 ; R2#20.2 26.36,13.63 LED2#20.1 ; LED2#14.1 141.61,174.26 R2#14.2 ; LED2#30.1 64.78,142.13 R2#25.2 ; LED2#23.1 26.36,110.01 R2#23.2 ; R2#19.2 26.36,142.13 LED2#19.1 ; R2#4.2 103.2,206.38 LED2#4.1 ; R2.2 26.36,238.51 LED2.1 ; R2#24.2 26.36,206.38 LED2#24.1 ; LED2#18.1 141.61,77.88 R2#15.2 ; LED2#6.1 26.36,174.26 R2#6.2 ; LED2#2.1 103.2,13.63 R2#3.2 ; LED2#10.1 103.2,77.88 R2#7.2
$1N1968: length 52
  Top Layer w0.254: R3#25.2 LED3#27.1 ; R3#18.2 LED3#17.1 ; R3#20.2 LED3#21.1 ; R3#15.2 LED3#11.1 ; R3#19.2 LED3#19.1 ; R3#12.2 LED3#12.1 ; R3#8.2 LED3#7.1 ; R3#24.2 LED3#24.1 ; R3#13.2 LED3#15.1 ; R3#4.2 LED3.1 ; R3#7.2 LED3#8.1 ; R3#30.2 LED3#30.1 ; R3#26.2 LED3#26.1 ; R3#17.2 LED3#14.1 ; R3.2 LED3#6.1 ; R3#27.2 LED3#29.1 ; R3#21.2 LED3#20.1 ; R3#16.2 LED3#16.1 ; R3#6.2 LED3#4.1 ; R3#28.2 LED3#32.1 ; R3#9.2 LED3#9.1 ; R3#23.2 LED3#23.1 ; R3#3.2 LED3#5.1 ; R3#29.2 LED3#25.1 ; R3#10.2 LED3#13.1 ; R3#22.2 LED3#22.1 ; R3#2.2 LED3#3.1 ; R3#14.2 LED3#18.1 ; R3#11.2 LED3#2.1 ; R3#5.2 LED3#10.1 ; R3#31.2 LED3#28.1 ; R3#32.2 LED3#31.1
$1N2989: length 686.9
  Top Layer w0.254: R4#7.1 96.53,239.39 U3#4.6 93.98,239.39 92.07,237.49 83.66,237.49 81.78,239.36 81.78,241.68 82.67,242.57 H7#7.1 ; H7#31.1 44.26,210.45 43.37,209.56 43.37,207.24 45.24,205.37 53.66,205.37 55.56,207.27 U3#26.6 58.11,207.27 R4#25.1 ; R4#23.1 19.69,110.9 U3#23.6 17.15,110.9 15.24,108.99 6.83,108.99 4.95,110.87 4.95,113.18 5.84,114.07 H7#23.1 ; H7#29.1 44.26,81.95 43.37,81.06 43.37,78.74 45.24,76.87 53.66,76.87 55.56,78.77 U3#32.6 58.11,78.77 R4#26.1 ; R4#3.1 19.69,239.39 U3#5.6 17.15,239.39 15.24,237.49 6.83,237.49 4.95,239.36 4.95,241.68 5.84,242.57 H7#6.1 ; R4#5.1 96.53,14.52 U3#3.6 93.98,14.52 92.07,12.62 83.66,12.62 81.78,14.49 81.78,16.81 82.67,17.7 H7.1 ; H7#3.1 82.67,114.07 81.78,113.18 81.78,110.87 83.66,108.99 92.07,108.99 93.98,110.9 U3#8.6 96.53,110.9 R4#9.1 ; H7#8.1 82.67,210.45 81.78,209.56 81.78,207.24 83.66,205.37 92.07,205.37 93.98,207.27 U3#2.6 96.53,207.27 R4#2.1 ; H7#21.1 5.84,81.95 4.95,81.06 4.95,78.74 6.83,76.87 15.24,76.87 17.15,78.77 U3#20.6 19.69,78.77 R4#20.1 ; R4#24.1 19.69,207.27 U3#24.6 17.15,207.27 15.24,205.37 6.83,205.37 4.95,207.24 4.95,209.56 5.84,210.45 H7#24.1 ; H7#26.1 44.26,146.2 43.37,145.31 43.37,142.99 45.24,141.12 53.66,141.12 55.56,143.02 U3#30.6 58.11,143.02 R4#28.1 ; H7#30.1 44.26,242.57 43.37,241.68 43.37,239.36 45.24,237.49 53.66,237.49 55.56,239.39 U3#28.6 58.11,239.39 R4#30.1 ; H7#16.1 5.84,178.32 4.95,177.43 4.95,175.12 6.83,173.24 15.24,173.24 17.15,175.15 U3#18.6 19.69,175.15 R4#17.1 ; H7#15.1 121.09,242.57 120.2,241.68 120.2,239.36 122.08,237.49 130.49,237.49 132.39,239.39 U3#13.6 134.94,239.39 R4#15.1 ; R4#29.1 58.11,46.65 U3#25.6 55.56,46.65 53.66,44.74 45.24,44.74 43.37,46.62 43.37,48.93 44.26,49.82 H7#28.1 ; R4#16.1 134.94,175.15 U3#14.6 132.39,175.15 130.49,173.24 122.08,173.24 120.2,175.12 120.2,177.43 121.09,178.32 H7#18.1 ; R4#14.1 134.94,46.65 U3#10.6 132.39,46.65 130.49,44.74 122.08,44.74 120.2,46.62 120.2,48.93 121.09,49.82 H7#13.1 ; R4#10.1 134.94,207.27 U3#11.6 132.39,207.27 130.49,205.37 122.08,205.37 120.2,207.24 120.2,209.56 121.09,210.45 H7#17.1 ; H7#19.1 5.84,146.2 4.95,145.31 4.95,142.99 6.83,141.12 15.24,141.12 17.15,143.02 U3#19.6 19.69,143.02 R4#19.1 ; H7#12.1 121.09,114.07 120.2,113.18 120.2,110.87 122.08,108.99 130.49,108.99 132.39,110.9 U3#16.6 134.94,110.9 R4#18.1 ; R4#22.1 19.69,46.65 U3#22.6 17.15,46.65 15.24,44.74 6.83,44.74 4.95,46.62 4.95,48.93 5.84,49.82 H7#22.1 ; H7#14.1 121.09,81.95 120.2,81.06 120.2,78.74 122.08,76.87 130.49,76.87 132.39,78.77 U3#17.6 134.94,78.77 R4#11.1 ; R4#6.1 96.53,46.65 U3.6 93.98,46.65 92.07,44.74 83.66,44.74 81.78,46.62 81.78,48.93 82.67,49.82 H7#4.1 ; H7#32.1 44.26,178.32 43.37,177.43 43.37,175.12 45.24,173.24 53.66,173.24 55.56,175.15 U3#29.6 58.11,175.15 R4#31.1 ; R4.1 96.53,143.02 U3#7.6 93.98,143.02 92.07,141.12 83.66,141.12 81.78,142.99 81.78,145.31 82.67,146.2 H7#2.1 ; R4#4.1 96.53,78.77 U3#9.6 93.98,78.77 92.07,76.87 83.66,76.87 81.78,78.74 81.78,81.06 82.67,81.95 H7#5.1 ; R4#13.1 134.94,143.02 U3#15.6 132.39,143.02 130.49,141.12 122.08,141.12 120.2,142.99 120.2,145.31 121.09,146.2 H7#11.1 ; R4#8.1 96.53,175.15 U3#6.6 93.98,175.15 92.07,173.24 83.66,173.24 81.78,175.12 81.78,177.43 82.67,178.32 H7#9.1 ; H7#27.1 44.26,114.07 43.37,113.18 43.37,110.87 45.24,108.99 53.66,108.99 55.56,110.9 U3#31.6 58.11,110.9 R4#32.1 ; H7#25.1 44.26,17.7 43.37,16.81 43.37,14.49 45.24,12.62 53.66,12.62 55.56,14.52 U3#27.6 58.11,14.52 R4#27.1 ; H7#10.1 121.09,17.7 120.2,16.81 120.2,14.49 122.08,12.62 130.49,12.62 132.39,14.52 U3#12.6 134.94,14.52 R4#12.1 ; H7#20.1 5.84,17.7 4.95,16.81 4.95,14.49 6.83,12.62 15.24,12.62 17.15,14.52 U3#21.6 19.69,14.52 R4#21.1
$1N3006: length 789.7
  Top Layer w0.254: R5#26.2 57.86,77.5 U3#32.5 55.43,77.5 54.04,76.11 45.25,76.11 42.99,78.37 42.99,82.71 H8#29.2 ; R5#2.2 96.27,141.75 U3#7.5 93.85,141.75 92.45,140.35 83.66,140.35 81.4,142.61 81.4,146.96 H8#4.2 ; H8#17.2 4.57,179.08 4.57,174.74 6.83,172.48 15.62,172.48 17.02,173.88 U3#18.5 19.44,173.88 R5#18.2 ; R5#31.2 57.86,238.12 U3#28.5 55.43,238.12 54.04,236.73 45.25,236.73 42.99,238.99 42.99,243.33 H8#31.2 ; H8#11.2 119.82,18.46 119.82,14.12 122.08,11.86 130.87,11.86 132.27,13.25 U3#12.5 134.69,13.25 R5#10.2 ; H8#28.2 42.99,146.96 42.99,142.61 45.25,140.35 54.04,140.35 55.43,141.75 U3#30.5 57.86,141.75 R5#24.2 ; H8#16.2 119.82,243.33 119.82,238.99 122.08,236.73 130.87,236.73 132.27,238.12 U3#13.5 134.69,238.12 R5#17.2 ; R5#30.2 57.86,45.38 U3#25.5 55.43,45.38 54.04,43.98 45.25,43.98 42.99,46.24 42.99,50.59 H8#30.2 ; H8#22.2 4.57,50.59 4.57,46.24 6.83,43.98 15.62,43.98 17.02,45.38 U3#22.5 19.44,45.38 R5#22.2 ; R5#15.2 134.69,173.88 U3#14.5 132.27,173.88 130.87,172.48 122.08,172.48 119.82,174.74 119.82,179.08 H8#18.2 ; R5#32.2 96.27,13.25 U3#3.5 93.85,13.25 92.45,11.86 83.66,11.86 81.4,14.12 81.4,18.46 H8#2.2 ; H8#26.2 42.99,18.46 42.99,14.12 45.25,11.86 54.04,11.86 55.43,13.25 U3#27.5 57.86,13.25 R5#23.2 ; H8#12.2 119.82,211.21 119.82,206.86 122.08,204.6 130.87,204.6 132.27,206 U3#11.5 134.69,206 R5#14.2 ; H8#7.2 81.4,243.33 81.4,238.99 83.66,236.73 92.45,236.73 93.85,238.12 U3#4.5 96.27,238.12 R5#9.2 ; R5.2 19.44,109.63 U3#23.5 17.02,109.63 15.62,108.23 6.83,108.23 4.57,110.49 4.57,114.83 H8#23.2 ; H8#15.2 119.82,50.59 119.82,46.24 122.08,43.98 130.87,43.98 132.27,45.38 U3#10.5 134.69,45.38 R5#16.2 ; R5#27.2 57.86,206 U3#26.5 55.43,206 54.04,204.6 45.25,204.6 42.99,206.86 42.99,211.21 H8#27.2 ; H8#10.2 119.82,114.83 119.82,110.49 122.08,108.23 130.87,108.23 132.27,109.63 U3#16.5 134.69,109.63 R5#12.2 ; R5#7.2 96.27,173.88 U3#6.5 93.85,173.88 92.45,172.48 83.66,172.48 81.4,174.74 81.4,179.08 H8#9.2 ; H8#25.2 42.99,114.83 42.99,110.49 45.25,108.23 54.04,108.23 55.43,109.63 U3#31.5 57.86,109.63 R5#25.2 ; H8#13.2 119.82,146.96 119.82,142.61 122.08,140.35 130.87,140.35 132.27,141.75 U3#15.5 134.69,141.75 R5#11.2 ; H8#20.2 4.57,18.46 4.57,14.12 6.83,11.86 15.62,11.86 17.02,13.25 U3#21.5 19.44,13.25 R5#20.2 ; R5#13.2 134.69,77.5 U3#17.5 132.27,77.5 130.87,76.11 122.08,76.11 119.82,78.37 119.82,82.71 H8#14.2 ; R5#8.2 96.27,45.38 U3.5 93.85,45.38 92.45,43.98 83.66,43.98 81.4,46.24 81.4,50.59 H8#6.2 ; H8#24.2 4.57,211.21 4.57,206.86 6.83,204.6 15.62,204.6 17.02,206 U3#24.5 19.44,206 R5#29.2 ; H8#21.2 4.57,82.71 4.57,78.37 6.83,76.11 15.62,76.11 17.02,77.5 U3#20.5 19.44,77.5 R5#21.2 ; R5#28.2 57.86,173.88 U3#29.5 55.43,173.88 54.04,172.48 45.25,172.48 42.99,174.74 42.99,179.08 H8#32.2 ; R5#6.2 96.27,206 U3#2.5 93.85,206 92.45,204.6 83.66,204.6 81.4,206.86 81.4,211.21 H8#3.2 ; H8#8.2 4.57,243.33 4.57,238.99 6.83,236.73 15.62,236.73 17.02,238.12 U3#5.5 19.44,238.12 R5#4.2 ; R5#3.2 96.27,109.63 U3#8.5 93.85,109.63 92.45,108.23 83.66,108.23 81.4,110.49 81.4,114.83 H8.2 ; H8#19.2 4.57,146.96 4.57,142.61 6.83,140.35 15.62,140.35 17.02,141.75 U3#19.5 19.44,141.75 R5#19.2 ; R5#5.2 96.27,77.5 U3#9.5 93.85,77.5 92.45,76.11 83.66,76.11 81.4,78.37 81.4,82.71 H8#5.2

## Copper pours and planes (outline as drawn; the poured copper is in the pictures)
GND on Top Layer: 0,288 161,288 161,0 0,0
GND on Bottom Layer: 0,288 161,288 161,0 0,0

## Text on the board
Top Silkscreen Layer: PT32x007_Fox01_HTOL_Test_2.0 | 澎湃微电子
